# EasyEDA Pro project wukong01-Y003-HTOL - 2.eprj, board PCB1 (continued)
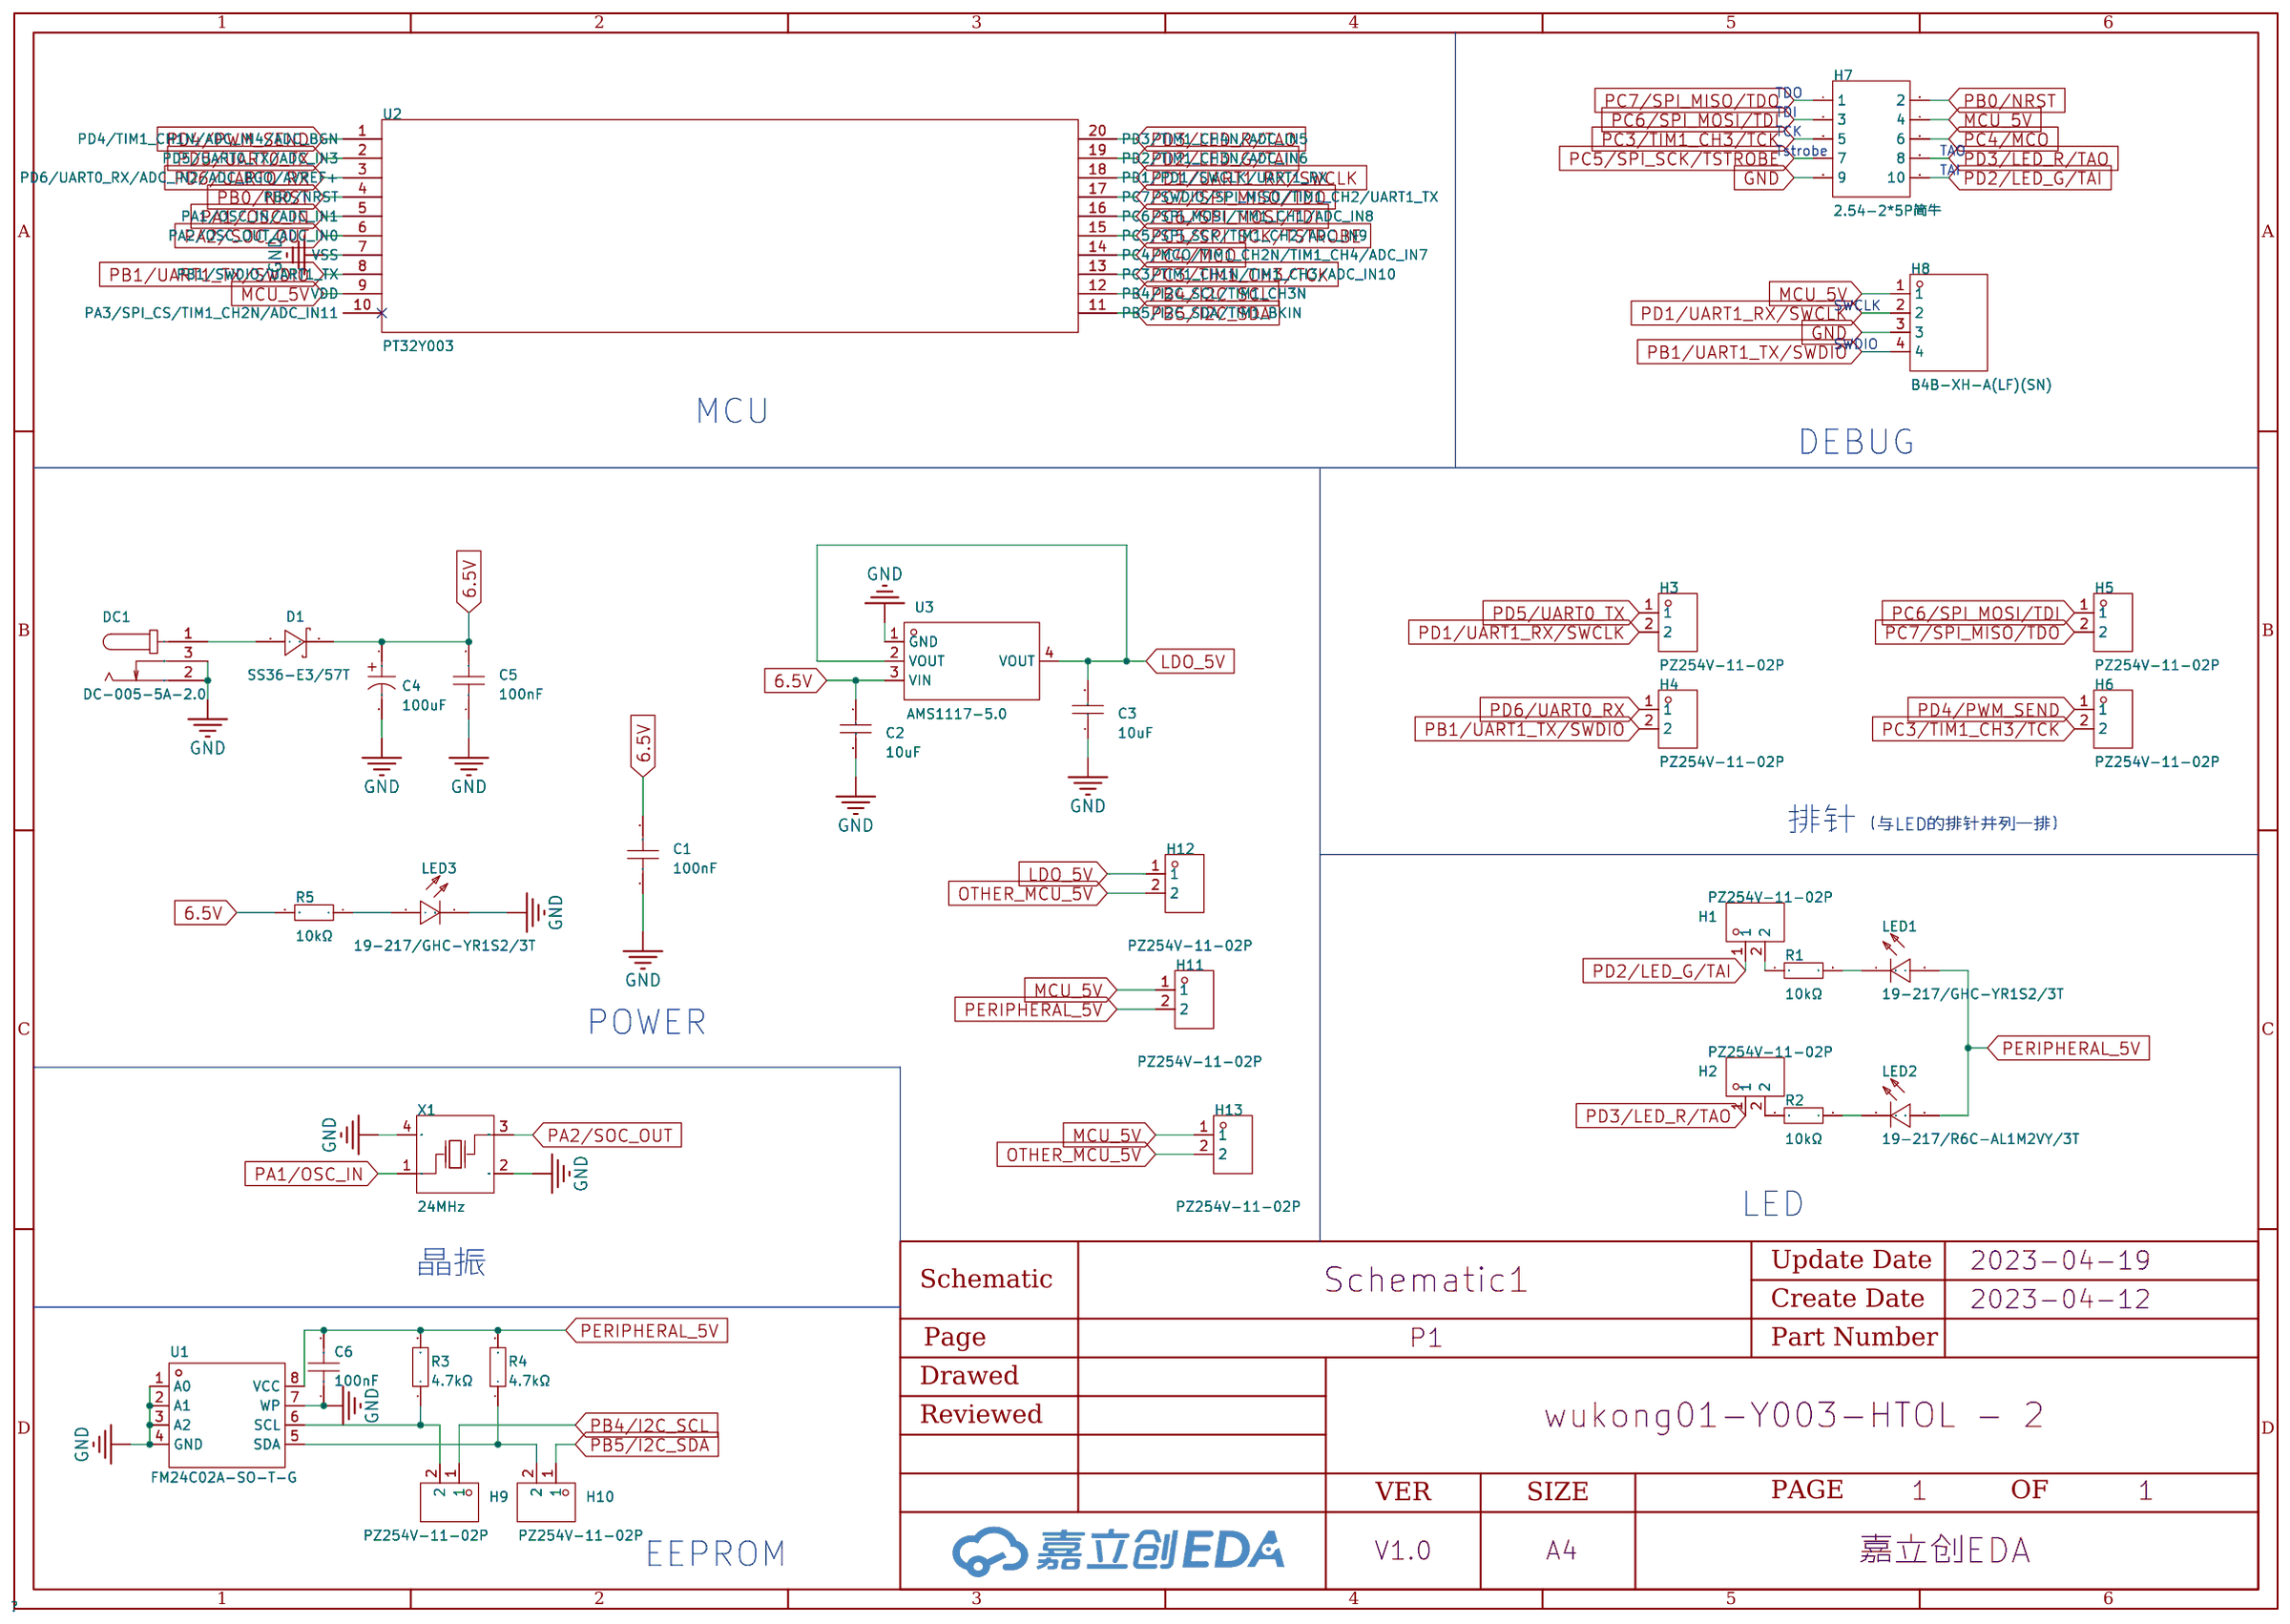
[diagram p0: schematic sheet]
## Routing (per net, layer and track width the routed paths; a pad name or vN(x,y) marks a point on that pad's centre or on a via; arc(x,y) is an arc through that point) (continued)
PD2/LED_G/TAI: length 965.4
  Top Layer w0.254: U2#20.19 217.55,99.87 v1(221.15,99.87) 227.24,99.87 H1#17.1 ; U2#4.19 217.55,213.87 v1(221.15,213.87) 227.24,213.87 H1#4.1 ; U2.19 82.55,213.87 v1(86.15,213.87) 92.24,213.87 H1.1 ; H1#2.1 137.24,213.87 v1(131.15,213.87) 127.55,213.87 U2#2.19 ; H1#13.1 137.24,137.87 v1(131.15,137.87) 127.55,137.87 U2#12.19 ; H1#10.1 47.24,175.87 v1(41.15,175.87) 37.55,175.87 U2#10.19 ; U2#6.19 127.55,175.87 v1(131.15,175.87) 137.24,175.87 H1#7.1 ; U2#21.19 262.55,99.87 v1(266.15,99.87) 272.24,99.87 H1#21.1 ; H1#11.1 227.24,137.87 v1(221.15,137.87) 217.55,137.87 U2#14.19 ; H1#22.1 47.24,99.87 v1(41.15,99.87) 37.55,99.87 U2#22.19 ; H1#25.1 137.24,61.87 v1(131.15,61.87) 127.55,61.87 U2#24.19 ; U2#17.19 82.55,99.87 v1(86.15,99.87) 92.24,99.87 H1#18.1 ; H1#20.1 182.24,99.87 v1(176.15,99.87) 172.55,99.87 U2#19.19 ; H1#27.1 272.24,61.87 v1(266.15,61.87) 262.55,61.87 U2#27.19 ; U2#8.19 217.55,175.87 v1(221.15,175.87) 227.24,175.87 H1#5.1 ; H1#23.1 227.24,61.87 v1(221.15,61.87) 217.55,61.87 U2#26.19 ; U2#16.19 37.55,137.87 v1(41.15,137.87) 47.24,137.87 H1#16.1 ; H1#3.1 182.24,213.87 v1(176.15,213.87) 172.55,213.87 U2#3.19 ; H1#28.1 47.24,61.87 v1(41.15,61.87) 37.55,61.87 U2#28.19 ; H1#26.1 182.24,61.87 v1(176.15,61.87) 172.55,61.87 U2#25.19 ; H1#14.1 182.24,137.87 v1(176.15,137.87) 172.55,137.87 U2#13.19 ; U2#5.19 82.55,175.87 v1(86.15,175.87) 92.24,175.87 H1#6.1 ; U2#15.19 262.55,137.87 v1(266.15,137.87) 272.24,137.87 H1#15.1 ; U2#11.19 82.55,137.87 v1(86.15,137.87) 92.24,137.87 H1#12.1 ; U2#7.19 172.55,175.87 v1(176.15,175.87) 182.24,175.87 H1#8.1 ; U2#30.19 127.55,23.87 v1(131.15,23.87) 137.24,23.87 H1#31.1 ; U2#32.19 217.55,23.87 v1(221.15,23.87) 227.24,23.87 H1#29.1 ; H1#30.1 92.24,23.87 v1(86.15,23.87) 82.55,23.87 U2#29.19 ; H1#19.1 137.24,99.87 v1(131.15,99.87) 127.55,99.87 U2#18.19 ; U2#31.19 172.55,23.87 v1(176.15,23.87) 182.24,23.87 H1#32.1 ; U2#9.19 262.55,175.87 v1(266.15,175.87) 272.24,175.87 H1#9.1 ; U2#23.19 82.55,61.87 v1(86.15,61.87) 92.24,61.87 H1#24.1
  Bottom Layer w0.254: H7#16.10 254.59,144.73 255.48,143.84 265.51,143.84 266.15,143.2 v1(266.15,137.87) ; v1(131.15,175.87) 131.15,181.2 130.51,181.84 120.48,181.84 119.59,182.73 H7#6.10 ; 209.59,31.87 209.59,30.73 210.48,29.84 220.51,29.84 221.15,29.2 v1(221.15,23.87) ; H7#13.10 164.59,144.73 165.48,143.84 175.51,143.84 176.15,143.2 v1(176.15,137.87) ; v1(86.15,99.87) 86.15,105.2 85.51,105.84 75.48,105.84 74.59,106.73 H7#17.10 ; H7#9.10 29.59,182.73 30.48,181.84 40.51,181.84 41.15,181.2 v1(41.15,175.87) ; v1(176.15,99.87) 176.15,105.2 175.51,105.84 165.48,105.84 164.59,106.73 H7#19.10 ; v1(86.15,61.87) 86.15,67.2 85.51,67.84 75.48,67.84 74.59,68.73 74.59,69.87 ; v1(176.15,23.87) 176.15,29.2 175.51,29.84 165.48,29.84 164.59,30.73 164.59,31.87 ; H7#7.10 164.59,182.73 165.48,181.84 175.51,181.84 176.15,181.2 v1(176.15,175.87) ; v1(131.15,23.87) 131.15,29.2 130.51,29.84 120.48,29.84 119.59,30.73 119.59,31.87 ; v1(221.15,99.87) 221.15,105.2 220.51,105.84 210.48,105.84 209.59,106.73 H7#20.10 ; v1(221.15,61.87) 221.15,67.2 220.51,67.84 210.48,67.84 209.59,68.73 209.59,69.87 ; H7.10 74.59,220.73 75.48,219.84 85.51,219.84 86.15,219.2 v1(86.15,213.87) ; H7#21.10 29.59,106.73 30.48,105.84 40.51,105.84 41.15,105.2 v1(41.15,99.87) ; H7#22.10 254.59,106.73 255.48,105.84 265.51,105.84 266.15,105.2 v1(266.15,99.87) ; v1(176.15,61.87) 176.15,67.2 175.51,67.84 165.48,67.84 164.59,68.73 164.59,69.87 ; H7#18.10 119.59,106.73 120.48,105.84 130.51,105.84 131.15,105.2 v1(131.15,99.87) ; H7#14.10 209.59,144.73 210.48,143.84 220.51,143.84 221.15,143.2 v1(221.15,137.87) ; H7#10.10 254.59,182.73 255.48,181.84 265.51,181.84 266.15,181.2 v1(266.15,175.87) ; H7#4.10 209.59,220.73 210.48,219.84 220.51,219.84 221.15,219.2 v1(221.15,213.87) ; v1(221.15,175.87) 221.15,181.2 220.51,181.84 210.48,181.84 209.59,182.73 H7#8.10 ; v1(266.15,61.87) 266.15,67.2 265.51,67.84 255.48,67.84 254.59,68.73 254.59,69.87 ; 74.59,31.87 74.59,30.73 75.48,29.84 85.51,29.84 86.15,29.2 v1(86.15,23.87) ; H7#3.10 164.59,220.73 165.48,219.84 175.51,219.84 176.15,219.2 v1(176.15,213.87) ; H7#11.10 74.59,144.73 75.48,143.84 85.51,143.84 86.15,143.2 v1(86.15,137.87) ; H7#15.10 29.59,144.73 30.48,143.84 40.51,143.84 41.15,143.2 v1(41.15,137.87) ; v1(41.15,61.87) 41.15,67.2 40.51,67.84 30.48,67.84 29.59,68.73 29.59,69.87 ; v1(131.15,61.87) 131.15,67.2 130.51,67.84 120.48,67.84 119.59,68.73 119.59,69.87 ; H7#5.10 74.59,182.73 75.48,181.84 85.51,181.84 86.15,181.2 v1(86.15,175.87) ; v1(131.15,213.87) 131.15,219.2 130.51,219.84 120.48,219.84 119.59,220.73 H7#2.10 ; H7#12.10 119.59,144.73 120.48,143.84 130.51,143.84 131.15,143.2 v1(131.15,137.87)
PD3/LED_R/TAO: length 921
  Top Layer w0.254: v1(77.13,181.2) H7#5.8 ; H2#25.1 227.5,65.68 226.99,65.17 226.99,63.39 226.1,62.5 v1(220.51,62.5) 217.55,62.5 U2#26.20 ; H2#21.1 272.5,103.68 271.99,103.17 271.99,101.39 271.1,100.5 v1(265.51,100.5) 262.55,100.5 U2#21.20 ; v1(212.13,105.2) H7#20.8 ; H2#17.1 92.5,103.68 91.99,103.17 91.99,101.39 91.1,100.5 v1(85.51,100.5) 82.55,100.5 U2#17.20 ; v1(77.13,29.2) 77.13,31.87 ; v1(167.13,29.2) 167.13,31.87 ; U2#30.20 127.55,24.5 v1(130.51,24.5) 136.1,24.5 136.99,25.39 136.99,27.17 137.5,27.68 H2#32.1 ; H2#5.1 92.5,179.68 91.99,179.17 91.99,177.39 91.1,176.5 v1(85.51,176.5) 82.55,176.5 U2#5.20 ; v1(167.13,181.2) H7#7.8 ; H2#30.1 182.5,27.68 181.99,27.17 181.99,25.39 181.1,24.5 v1(175.51,24.5) 172.55,24.5 U2#31.20 ; U2#12.20 127.55,138.5 v1(130.51,138.5) 136.1,138.5 136.99,139.39 136.99,141.17 137.5,141.68 H2#14.1 ; H2#7.1 227.5,179.68 226.99,179.17 226.99,177.39 226.1,176.5 v1(220.51,176.5) 217.55,176.5 U2#8.20 ; U2#32.20 217.55,24.5 v1(220.51,24.5) 226.1,24.5 226.99,25.39 226.99,27.17 227.5,27.68 H2#31.1 ; H2#3.1 182.5,217.68 181.99,217.17 181.99,215.39 181.1,214.5 v1(175.51,214.5) 172.55,214.5 U2#3.20 ; v1(167.13,105.2) H7#19.8 ; H2#29.1 92.5,27.68 91.99,27.17 91.99,25.39 91.1,24.5 v1(85.51,24.5) 82.55,24.5 U2#29.20 ; v1(257.13,143.2) H7#16.8 ; v1(212.13,181.2) H7#8.8 ; H2#24.1 182.5,65.68 181.99,65.17 181.99,63.39 181.1,62.5 v1(175.51,62.5) 172.55,62.5 U2#25.20 ; H2#8.1 137.5,179.68 136.99,179.17 136.99,177.39 136.1,176.5 v1(130.51,176.5) 127.55,176.5 U2#6.20 ; U2.20 82.55,214.5 v1(85.51,214.5) 91.1,214.5 91.99,215.39 91.99,217.17 92.5,217.68 H2.1 ; v1(122.13,67.2) 122.13,69.87 ; U2#9.20 262.55,176.5 v1(265.51,176.5) 271.1,176.5 271.99,177.39 271.99,179.17 272.5,179.68 H2#9.1 ; H2#18.1 182.5,103.68 181.99,103.17 181.99,101.39 181.1,100.5 v1(175.51,100.5) 172.55,100.5 U2#19.20 ; v1(77.13,105.2) H7#17.8 ; U2#7.20 172.55,176.5 v1(175.51,176.5) 181.1,176.5 181.99,177.39 181.99,179.17 182.5,179.68 H2#6.1 ; v1(32.13,143.2) H7#15.8 ; U2#13.20 172.55,138.5 v1(175.51,138.5) 181.1,138.5 181.99,139.39 181.99,141.17 182.5,141.68 H2#12.1 ; H2#19.1 227.5,103.68 226.99,103.17 226.99,101.39 226.1,100.5 v1(220.51,100.5) 217.55,100.5 U2#20.20 ; v1(122.13,105.2) H7#18.8 ; H2#26.1 137.5,65.68 136.99,65.17 136.99,63.39 136.1,62.5 v1(130.51,62.5) 127.55,62.5 U2#24.20 ; v1(122.13,29.2) 122.13,31.87 ; v1(32.13,105.2) H7#21.8 ; v1(167.13,219.2) H7#3.8 ; U2#15.20 262.55,138.5 v1(265.51,138.5) 271.1,138.5 271.99,139.39 271.99,141.17 272.5,141.68 H2#15.1 ; v1(257.13,67.2) 257.13,69.87 ; v1(122.13,143.2) H7#12.8 ; U2#27.20 262.55,62.5 v1(265.51,62.5) 271.1,62.5 271.99,63.39 271.99,65.17 272.5,65.68 H2#27.1 ; v1(77.13,143.2) H7#11.8 ; U2#2.20 127.55,214.5 v1(130.51,214.5) 136.1,214.5 136.99,215.39 136.99,217.17 137.5,217.68 H2#2.1 ; v1(32.13,67.2) 32.13,69.87 ; U2#23.20 82.55,62.5 v1(85.51,62.5) 91.1,62.5 91.99,63.39 91.99,65.17 92.5,65.68 H2#23.1 ; H2#28.1 47.5,65.68 46.99,65.17 46.99,63.39 46.1,62.5 v1(40.51,62.5) 37.55,62.5 U2#28.20 ; U2#22.20 37.55,100.5 v1(40.51,100.5) 46.1,100.5 46.99,101.39 46.99,103.17 47.5,103.68 H2#22.1 ; U2#16.20 37.55,138.5 v1(40.51,138.5) 46.1,138.5 46.99,139.39 46.99,141.17 47.5,141.68 H2#16.1 ; H2#20.1 137.5,103.68 136.99,103.17 136.99,101.39 136.1,100.5 v1(130.51,100.5) 127.55,100.5 U2#18.20 ; v1(122.13,219.2) H7#2.8 ; H2#13.1 227.5,141.68 226.99,141.17 226.99,139.39 226.1,138.5 v1(220.51,138.5) 217.55,138.5 U2#14.20 ; H2#11.1 92.5,141.68 91.99,141.17 91.99,139.39 91.1,138.5 v1(85.51,138.5) 82.55,138.5 U2#11.20 ; U2#10.20 37.55,176.5 v1(40.51,176.5) 46.1,176.5 46.99,177.39 46.99,179.17 47.5,179.68 H2#10.1 ; v1(122.13,181.2) H7#6.8 ; U2#4.20 217.55,214.5 v1(220.51,214.5) 226.1,214.5 226.99,215.39 226.99,217.17 227.5,217.68 H2#4.1 ; v1(167.13,67.2) 167.13,69.87 ; v1(77.13,219.2) H7.8 ; v1(257.13,105.2) H7#22.8 ; v1(212.13,29.2) 212.13,31.87 ; v1(167.13,143.2) H7#13.8 ; v1(212.13,219.2) H7#4.8 ; v1(77.13,67.2) 77.13,69.87 ; v1(257.13,181.2) H7#10.8 ; v1(32.13,181.2) H7#9.8 ; v1(212.13,67.2) 212.13,69.87 ; v1(212.13,143.2) H7#14.8
  Bottom Layer w0.254: v1(257.13,105.2) 265,105.2 265.51,104.69 v1(265.51,100.5) ; v1(122.13,29.2) 130,29.2 130.51,28.69 v1(130.51,24.5) ; v1(212.13,67.2) 220,67.2 220.51,66.69 v1(220.51,62.5) ; v1(167.13,29.2) 175,29.2 175.51,28.69 v1(175.51,24.5) ; v1(85.51,214.5) 85.51,218.69 85.01,219.2 v1(77.13,219.2) ; v1(122.13,181.2) 130,181.2 130.51,180.69 v1(130.51,176.5) ; v1(85.51,62.5) 85.51,66.69 85.01,67.2 v1(77.13,67.2) ; v1(257.13,67.2) 265,67.2 265.51,66.69 v1(265.51,62.5) ; v1(257.13,143.2) 265,143.2 265.51,142.69 v1(265.51,138.5) ; v1(220.51,138.5) 220.51,142.69 220,143.2 v1(212.13,143.2) ; v1(40.51,138.5) 40.51,142.69 40.01,143.2 v1(32.13,143.2) ; v1(167.13,219.2) 175,219.2 175.51,218.69 v1(175.51,214.5) ; v1(220.51,100.5) 220.51,104.69 220,105.2 v1(212.13,105.2) ; v1(32.13,105.2) 40.01,105.2 40.51,104.69 v1(40.51,100.5) ; v1(40.51,176.5) 40.51,180.69 40.01,181.2 v1(32.13,181.2) ; v1(122.13,143.2) 130,143.2 130.51,142.69 v1(130.51,138.5) ; v1(85.51,176.5) 85.51,180.69 85.01,181.2 v1(77.13,181.2) ; v1(77.13,143.2) 85.01,143.2 85.51,142.69 v1(85.51,138.5) ; v1(167.13,143.2) 175,143.2 175.51,142.69 v1(175.51,138.5) ; v1(175.51,100.5) 175.51,104.69 175,105.2 v1(167.13,105.2) ; v1(220.51,214.5) 220.51,218.69 220,219.2 v1(212.13,219.2) ; v1(130.51,62.5) 130.51,66.69 130,67.2 v1(122.13,67.2) ; v1(175.51,62.5) 175.51,66.69 175,67.2 v1(167.13,67.2) ; v1(85.51,100.5) 85.51,104.69 85.01,105.2 v1(77.13,105.2) ; v1(40.51,62.5) 40.51,66.69 40.01,67.2 v1(32.13,67.2) ; v1(220.51,24.5) 220.51,28.69 220,29.2 v1(212.13,29.2) ; v1(85.51,24.5) 85.51,28.69 85.01,29.2 v1(77.13,29.2) ; v1(122.13,219.2) 130,219.2 130.51,218.69 v1(130.51,214.5) ; v1(220.51,176.5) 220.51,180.69 220,181.2 v1(212.13,181.2) ; v1(175.51,176.5) 175.51,180.69 175,181.2 v1(167.13,181.2) ; v1(130.51,100.5) 130.51,104.69 130,105.2 v1(122.13,105.2) ; v1(265.51,176.5) 265.51,180.69 265,181.2 v1(257.13,181.2)
PD4/PWM_SEND: length 756.9
  Top Layer w0.254: U2#19.1 165.86,100.51 165.66,100.71 165.66,101.06 165.86,101.27 180.72,101.27 181.48,102.03 181.48,105.58 182.12,106.22 H6#20.1 ; U2#10.1 30.86,176.51 30.66,176.71 30.66,177.06 30.86,177.26 45.72,177.26 46.48,178.03 46.48,181.58 47.12,182.22 H6#10.1 ; U2#23.1 75.86,62.51 75.66,62.71 75.66,63.06 75.86,63.26 90.72,63.26 91.48,64.03 91.48,67.58 92.12,68.22 H6#23.1 ; U2#16.1 30.86,138.51 30.66,138.71 30.66,139.06 30.86,139.26 45.72,139.26 46.48,140.03 46.48,143.58 47.12,144.22 H6#16.1 ; H6.1 92.12,220.22 91.48,219.58 91.48,216.03 90.72,215.26 75.86,215.26 75.66,215.06 75.66,214.71 75.86,214.51 U2.1 ; U2#9.1 255.86,176.51 255.66,176.71 255.66,177.06 255.86,177.26 270.72,177.26 271.48,178.03 271.48,181.58 272.12,182.22 H6#9.1 ; U2#29.1 75.86,24.51 75.66,24.71 75.66,25.06 75.86,25.26 90.72,25.26 91.48,26.03 91.48,29.58 92.12,30.22 H6#29.1 ; H6#5.1 92.12,182.22 91.48,181.58 91.48,178.03 90.72,177.26 75.86,177.26 75.66,177.06 75.66,176.71 75.86,176.51 U2#5.1 ; U2#20.1 210.86,100.51 210.66,100.71 210.66,101.06 210.86,101.27 225.72,101.27 226.48,102.03 226.48,105.58 227.12,106.22 H6#18.1 ; H6#11.1 92.12,144.22 91.48,143.58 91.48,140.03 90.72,139.26 75.86,139.26 75.66,139.06 75.66,138.71 75.86,138.51 U2#11.1 ; U2#7.1 165.86,176.51 165.66,176.71 165.66,177.06 165.86,177.26 180.72,177.26 181.48,178.03 181.48,181.58 182.12,182.22 H6#8.1 ; H6#21.1 272.12,106.22 271.48,105.58 271.48,102.03 270.72,101.27 255.86,101.27 255.66,101.06 255.66,100.71 255.86,100.51 U2#21.1 ; U2#31.1 165.86,24.51 165.66,24.71 165.66,25.06 165.86,25.26 180.72,25.26 181.48,26.03 181.48,29.58 182.12,30.22 H6#32.1 ; H6#3.1 182.12,220.22 181.48,219.58 181.48,216.03 180.72,215.26 165.86,215.26 165.66,215.06 165.66,214.71 165.86,214.51 U2#3.1 ; U2#15.1 255.86,138.51 255.66,138.71 255.66,139.06 255.86,139.26 270.72,139.26 271.48,140.03 271.48,143.58 272.12,144.22 H6#15.1 ; H6#28.1 47.12,68.22 46.48,67.58 46.48,64.03 45.72,63.26 30.86,63.26 30.66,63.06 30.66,62.71 30.86,62.51 U2#28.1 ; U2#13.1 165.86,138.51 165.66,138.71 165.66,139.06 165.86,139.26 180.72,139.26 181.48,140.03 181.48,143.58 182.12,144.22 H6#14.1 ; U2#17.1 75.86,100.51 75.66,100.71 75.66,101.06 75.86,101.27 90.72,101.27 91.48,102.03 91.48,105.58 92.12,106.22 H6#17.1 ; H6#26.1 182.12,68.22 181.48,67.58 181.48,64.03 180.72,63.26 165.86,63.26 165.66,63.06 165.66,62.71 165.86,62.51 U2#25.1 ; H6#7.1 137.12,182.22 136.48,181.58 136.48,178.03 135.72,177.26 120.86,177.26 120.66,177.06 120.66,176.71 120.86,176.51 U2#6.1 ; U2#26.1 210.86,62.51 210.66,62.71 210.66,63.06 210.86,63.26 225.72,63.26 226.48,64.03 226.48,67.58 227.12,68.22 H6#24.1 ; U2#18.1 120.86,100.51 120.66,100.71 120.66,101.06 120.86,101.27 135.72,101.27 136.48,102.03 136.48,105.58 137.12,106.22 H6#19.1 ; U2#32.1 210.86,24.51 210.66,24.71 210.66,25.06 210.86,25.26 225.72,25.26 226.48,26.03 226.48,29.58 227.12,30.22 H6#30.1 ; U2#12.1 120.86,138.51 120.66,138.71 120.66,139.06 120.86,139.26 135.72,139.26 136.48,140.03 136.48,143.58 137.12,144.22 H6#13.1 ; H6#2.1 137.12,220.22 136.48,219.58 136.48,216.03 135.72,215.26 120.86,215.26 120.66,215.06 120.66,214.71 120.86,214.51 U2#2.1 ; U2#4.1 210.86,214.51 210.66,214.71 210.66,215.06 210.86,215.26 225.72,215.26 226.48,216.03 226.48,219.58 227.12,220.22 H6#4.1 ; U2#8.1 210.86,176.51 210.66,176.71 210.66,177.06 210.86,177.26 225.72,177.26 226.48,178.03 226.48,181.58 227.12,182.22 H6#6.1 ; H6#27.1 272.12,68.22 271.48,67.58 271.48,64.03 270.72,63.26 255.86,63.26 255.66,63.06 255.66,62.71 255.86,62.51 U2#27.1 ; H6#12.1 227.12,144.22 226.48,143.58 226.48,140.03 225.72,139.26 210.86,139.26 210.66,139.06 210.66,138.71 210.86,138.51 U2#14.1 ; U2#30.1 120.86,24.51 120.66,24.71 120.66,25.06 120.86,25.26 135.72,25.26 136.48,26.03 136.48,29.58 137.12,30.22 H6#31.1 ; H6#25.1 137.12,68.22 136.48,67.58 136.48,64.03 135.72,63.26 120.86,63.26 120.66,63.06 120.66,62.71 120.86,62.51 U2#24.1 ; H6#22.1 47.12,106.22 46.48,105.58 46.48,102.03 45.72,101.27 30.86,101.27 30.66,101.06 30.66,100.71 30.86,100.51 U2#22.1
PD5/UART0_TX: length 901.2
  Top Layer w0.254: H3#26.1 183.39,70.63 181.99,70.63 181.1,69.74 181.1,64.66 180.21,63.77 165.1,63.77 164.8,63.48 164.8,62.12 165.07,61.86 U2#25.2 ; U2#5.2 75.07,175.86 74.81,176.12 74.81,177.48 75.1,177.77 90.21,177.77 91.1,178.66 91.1,183.74 91.99,184.63 93.39,184.63 H3#5.1 ; U2#20.2 210.07,99.86 209.8,100.12 209.8,101.48 210.1,101.77 225.21,101.77 226.1,102.66 226.1,107.74 226.99,108.63 228.39,108.63 H3#19.1 ; U2#26.2 210.07,61.86 209.8,62.12 209.8,63.48 210.1,63.77 225.21,63.77 226.1,64.66 226.1,69.74 226.99,70.63 228.39,70.63 H3#25.1 ; U2#16.2 30.07,137.86 29.8,138.12 29.8,139.48 30.1,139.77 45.21,139.77 46.1,140.66 46.1,145.74 46.99,146.63 48.39,146.63 H3#17.1 ; U2#24.2 120.07,61.86 119.81,62.12 119.81,63.48 120.1,63.77 135.21,63.77 136.1,64.66 136.1,69.74 136.99,70.63 138.39,70.63 H3#12.1 ; U2#32.2 210.07,23.86 209.8,24.12 209.8,25.48 210.1,25.77 225.21,25.77 226.1,26.66 226.1,31.74 226.99,32.63 228.39,32.63 H3#30.1 ; H3#28.1 48.39,70.63 46.99,70.63 46.1,69.74 46.1,64.66 45.21,63.77 30.1,63.77 29.8,63.48 29.8,62.12 30.07,61.86 U2#28.2 ; U2#22.2 30.07,99.86 29.8,100.12 29.8,101.48 30.1,101.77 45.21,101.77 46.1,102.66 46.1,107.74 46.99,108.63 48.39,108.63 H3#23.1 ; U2#13.2 165.07,137.86 164.8,138.12 164.8,139.48 165.1,139.77 180.21,139.77 181.1,140.66 181.1,145.74 181.99,146.63 183.39,146.63 H3#15.1 ; U2#17.2 75.07,99.86 74.81,100.12 74.81,101.48 75.1,101.77 90.21,101.77 91.1,102.66 91.1,107.74 91.99,108.63 93.39,108.63 H3#18.1 ; U2#9.2 255.07,175.86 254.81,176.12 254.81,177.48 255.1,177.77 270.21,177.77 271.1,178.66 271.1,183.74 271.99,184.63 273.39,184.63 H3#9.1 ; H3#32.1 183.39,32.63 181.99,32.63 181.1,31.74 181.1,26.66 180.21,25.77 165.1,25.77 164.8,25.48 164.8,24.12 165.07,23.86 U2#31.2 ; H3.1 93.39,222.63 91.99,222.63 91.1,221.74 91.1,216.66 90.21,215.77 75.1,215.77 74.81,215.48 74.81,214.12 75.07,213.86 U2.2 ; U2#7.2 165.07,175.86 164.8,176.12 164.8,177.48 165.1,177.77 180.21,177.77 181.1,178.66 181.1,183.74 181.99,184.63 183.39,184.63 H3#8.1 ; U2#29.2 75.07,23.86 74.81,24.12 74.81,25.48 75.1,25.77 90.21,25.77 91.1,26.66 91.1,31.74 91.99,32.63 93.39,32.63 H3#29.1 ; U2#2.2 120.07,213.86 119.81,214.12 119.81,215.48 120.1,215.77 135.21,215.77 136.1,216.66 136.1,221.74 136.99,222.63 138.39,222.63 H3#2.1 ; H3#16.1 273.39,146.63 271.99,146.63 271.1,145.74 271.1,140.66 270.21,139.77 255.1,139.77 254.81,139.48 254.81,138.12 255.07,137.86 U2#15.2 ; U2#4.2 210.07,213.86 209.8,214.12 209.8,215.48 210.1,215.77 225.21,215.77 226.1,216.66 226.1,221.74 226.99,222.63 228.39,222.63 H3#4.1 ; H3#11.1 93.39,146.63 91.99,146.63 91.1,145.74 91.1,140.66 90.21,139.77 75.1,139.77 74.81,139.48 74.81,138.12 75.07,137.86 U2#11.2 ; H3#3.1 183.39,222.63 181.99,222.63 181.1,221.74 181.1,216.66 180.21,215.77 165.1,215.77 164.8,215.48 164.8,214.12 165.07,213.86 U2#3.2 ; H3#13.1 228.39,146.63 226.99,146.63 226.1,145.74 226.1,140.66 225.21,139.77 210.1,139.77 209.8,139.48 209.8,138.12 210.07,137.86 U2#14.2 ; H3#14.1 138.39,146.63 136.99,146.63 136.1,145.74 136.1,140.66 135.21,139.77 120.1,139.77 119.81,139.48 119.81,138.12 120.07,137.86 U2#12.2 ; U2#21.2 255.07,99.86 254.81,100.12 254.81,101.48 255.1,101.77 270.21,101.77 271.1,102.66 271.1,107.74 271.99,108.63 273.39,108.63 H3#22.1 ; H3#10.1 48.39,184.63 46.99,184.63 46.1,183.74 46.1,178.66 45.21,177.77 30.1,177.77 29.8,177.48 29.8,176.12 30.07,175.86 U2#10.2 ; U2#27.2 255.07,61.86 254.81,62.12 254.81,63.48 255.1,63.77 270.21,63.77 271.1,64.66 271.1,69.74 271.99,70.63 273.39,70.63 H3#27.1 ; U2#18.2 120.07,99.86 119.81,100.12 119.81,101.48 120.1,101.77 135.21,101.77 136.1,102.66 136.1,107.74 136.99,108.63 138.39,108.63 H3#20.1 ; U2#23.2 75.07,61.86 74.81,62.12 74.81,63.48 75.1,63.77 90.21,63.77 91.1,64.66 91.1,69.74 91.99,70.63 93.39,70.63 H3#24.1 ; H3#21.1 183.39,108.63 181.99,108.63 181.1,107.74 181.1,102.66 180.21,101.77 165.1,101.77 164.8,101.48 164.8,100.12 165.07,99.86 U2#19.2 ; U2#8.2 210.07,175.86 209.8,176.12 209.8,177.48 210.1,177.77 225.21,177.77 226.1,178.66 226.1,183.74 226.99,184.63 228.39,184.63 H3#6.1 ; U2#6.2 120.07,175.86 119.81,176.12 119.81,177.48 120.1,177.77 135.21,177.77 136.1,178.66 136.1,183.74 136.99,184.63 138.39,184.63 H3#7.1 ; H3#31.1 138.39,32.63 136.99,32.63 136.1,31.74 136.1,26.66 135.21,25.77 120.1,25.77 119.81,25.48 119.81,24.12 120.07,23.86 U2#30.2
PD6/UART0_RX: length 1019.4
  Top Layer w0.254: H4#21.1 181.99,111.3 180.59,109.9 180.59,103.17 179.83,102.41 164.97,102.41 164.34,101.77 164.34,99.61 164.72,99.23 166.77,99.23 U2#19.3 ; U2#3.3 166.77,213.23 164.72,213.23 164.34,213.61 164.34,215.77 164.97,216.41 179.83,216.41 180.59,217.17 180.59,223.9 181.99,225.3 H4#3.1 ; H4#32.1 181.99,35.3 180.59,33.9 180.59,27.17 179.83,26.41 164.97,26.41 164.34,25.77 164.34,23.61 164.72,23.23 166.77,23.23 U2#31.3 ; U2#7.3 166.77,175.23 164.72,175.23 164.34,175.61 164.34,177.77 164.97,178.41 179.83,178.41 180.59,179.17 180.59,185.9 181.99,187.3 H4#9.1 ; H4#17.1 226.99,111.3 225.59,109.9 225.59,103.17 224.83,102.41 209.97,102.41 209.34,101.77 209.34,99.61 209.72,99.23 211.77,99.23 U2#20.3 ; U2#12.3 121.77,137.23 119.72,137.23 119.34,137.61 119.34,139.77 119.97,140.41 134.83,140.41 135.59,141.17 135.59,147.9 136.99,149.3 H4#13.1 ; H4#19.1 136.99,111.3 135.59,109.9 135.59,103.17 134.83,102.41 119.97,102.41 119.34,101.77 119.34,99.61 119.72,99.23 121.77,99.23 U2#18.3 ; U2#26.3 211.77,61.23 209.72,61.23 209.34,61.61 209.34,63.77 209.97,64.41 224.83,64.41 225.59,65.17 225.59,71.9 226.99,73.3 H4#23.1 ; H4#18.1 91.99,111.3 90.59,109.9 90.59,103.17 89.83,102.41 74.97,102.41 74.34,101.77 74.34,99.61 74.72,99.23 76.77,99.23 U2#17.3 ; U2#32.3 211.77,23.23 209.72,23.23 209.34,23.61 209.34,25.77 209.97,26.41 224.83,26.41 225.59,27.17 225.59,33.9 226.99,35.3 H4#29.1 ; U2#25.3 166.77,61.23 164.72,61.23 164.34,61.61 164.34,63.77 164.97,64.41 179.83,64.41 180.59,65.17 180.59,71.9 181.99,73.3 H4#27.1 ; U2#15.3 256.77,137.23 254.72,137.23 254.34,137.61 254.34,139.77 254.97,140.41 269.83,140.41 270.59,141.17 270.59,147.9 271.99,149.3 H4#16.1 ; U2#24.3 121.77,61.23 119.72,61.23 119.34,61.61 119.34,63.77 119.97,64.41 134.83,64.41 135.59,65.17 135.59,71.9 136.99,73.3 H4#25.1 ; U2#29.3 76.77,23.23 74.72,23.23 74.34,23.61 74.34,25.77 74.97,26.41 89.83,26.41 90.59,27.17 90.59,33.9 91.99,35.3 H4#30.1 ; U2#10.3 31.77,175.23 29.72,175.23 29.34,175.61 29.34,177.77 29.97,178.41 44.83,178.41 45.59,179.17 45.59,185.9 46.99,187.3 H4#8.1 ; U2#23.3 76.77,61.23 74.72,61.23 74.34,61.61 74.34,63.77 74.97,64.41 89.83,64.41 90.59,65.17 90.59,71.9 91.99,73.3 H4#24.1 ; H4#28.1 271.99,73.3 270.59,71.9 270.59,65.17 269.83,64.41 254.97,64.41 254.34,63.77 254.34,61.61 254.72,61.23 256.77,61.23 U2#27.3 ; H4#5.1 226.99,187.3 225.59,185.9 225.59,179.17 224.83,178.41 209.97,178.41 209.34,177.77 209.34,175.61 209.72,175.23 211.77,175.23 U2#8.3 ; H4#26.1 46.99,73.3 45.59,71.9 45.59,65.17 44.83,64.41 29.97,64.41 29.34,63.77 29.34,61.61 29.72,61.23 31.77,61.23 U2#28.3 ; H4#22.1 271.99,111.3 270.59,109.9 270.59,103.17 269.83,102.41 254.97,102.41 254.34,101.77 254.34,99.61 254.72,99.23 256.77,99.23 U2#21.3 ; H4#4.1 226.99,225.3 225.59,223.9 225.59,217.17 224.83,216.41 209.97,216.41 209.34,215.77 209.34,213.61 209.72,213.23 211.77,213.23 U2#4.3 ; H4#10.1 271.99,187.3 270.59,185.9 270.59,179.17 269.83,178.41 254.97,178.41 254.34,177.77 254.34,175.61 254.72,175.23 256.77,175.23 U2#9.3 ; U2#13.3 166.77,137.23 164.72,137.23 164.34,137.61 164.34,139.77 164.97,140.41 179.83,140.41 180.59,141.17 180.59,147.9 181.99,149.3 H4#15.1 ; U2#2.3 121.77,213.23 119.72,213.23 119.34,213.61 119.34,215.77 119.97,216.41 134.83,216.41 135.59,217.17 135.59,223.9 136.99,225.3 H4#2.1 ; U2#14.3 211.77,137.23 209.72,137.23 209.34,137.61 209.34,139.77 209.97,140.41 224.83,140.41 225.59,141.17 225.59,147.9 226.99,149.3 H4#11.1 ; U2#11.3 76.77,137.23 74.72,137.23 74.34,137.61 74.34,139.77 74.97,140.41 89.83,140.41 90.59,141.17 90.59,147.9 91.99,149.3 H4#12.1 ; U2#30.3 121.77,23.23 119.72,23.23 119.34,23.61 119.34,25.77 119.97,26.41 134.83,26.41 135.59,27.17 135.59,33.9 136.99,35.3 H4#31.1 ; U2#16.3 31.77,137.23 29.72,137.23 29.34,137.61 29.34,139.77 29.97,140.41 44.83,140.41 45.59,141.17 45.59,147.9 46.99,149.3 H4#14.1 ; U2#5.3 76.77,175.23 74.72,175.23 74.34,175.61 74.34,177.77 74.97,178.41 89.83,178.41 90.59,179.17 90.59,185.9 91.99,187.3 H4#6.1 ; H4#20.1 46.99,111.3 45.59,109.9 45.59,103.17 44.83,102.41 29.97,102.41 29.34,101.77 29.34,99.61 29.72,99.23 31.77,99.23 U2#22.3 ; U2.3 76.77,213.23 74.72,213.23 74.34,213.61 74.34,215.77 74.97,216.41 89.83,216.41 90.59,217.17 90.59,223.9 91.99,225.3 H4.1 ; H4#7.1 136.99,187.3 135.59,185.9 135.59,179.17 134.83,178.41 119.97,178.41 119.34,177.77 119.34,175.61 119.72,175.23 121.77,175.23 U2#6.3
PERIPHERAL_5V: length 2043.3
  Top Layer w0.5: 28.71,51.74 35.38,51.74 LED2#28.1 35.47,50.36 35.56,50.27 v1(35.56,45.1) 30.1,45.1 28.64,46.56 C6#28.2 28.58,53.81 28.58,55.01 28.19,55.39 22.73,55.39 22.35,55.01 22.35,54.4 U1#28.8 ; v1(142.83,121.1) 142.83,128.98 H11#12.2 ; 202.2,92.25 202.35,92.4 202.35,93.01 202.73,93.39 208.19,93.39 208.57,93.01 208.57,91.81 C6#20.2 208.64,84.56 210.1,83.1 v1(215.56,83.1) 215.56,88.27 215.47,88.36 LED2#20.1 215.38,89.74 208.71,89.74 ; 202.2,54.25 202.35,54.4 202.35,55.01 202.73,55.39 208.19,55.39 208.57,55.01 208.57,53.81 C6#26.2 208.64,46.56 210.1,45.1 v1(215.56,45.1) 215.56,50.27 215.47,50.36 LED2#26.1 215.38,51.74 208.71,51.74 ; v1(187.83,7.1) 187.83,14.98 H11#32.2 ; H11#31.2 97.83,14.98 v1(97.83,7.1) ; 73.71,13.74 80.38,13.74 LED2#30.1 80.47,12.36 80.56,12.27 v1(80.56,7.1) 75.1,7.1 73.64,8.56 73.64,15.74 73.58,15.81 73.58,17.01 73.19,17.39 67.73,17.39 67.35,17.01 67.35,16.4 U1#29.8 ; H11#19.2 97.83,90.98 v1(97.83,83.1) ; 73.71,203.74 80.38,203.74 LED2.1 80.47,202.36 80.56,202.27 v1(80.56,197.1) 75.1,197.1 73.64,198.56 73.64,205.74 73.58,205.81 73.58,207.01 73.19,207.39 67.73,207.39 67.35,207.01 67.35,206.4 U1.8 ; H11#11.2 232.83,128.98 v1(232.83,121.1) ; U1#12.8 67.35,130.4 67.35,131.01 67.73,131.39 73.19,131.39 73.58,131.01 73.58,129.81 73.64,129.74 73.64,122.56 75.1,121.1 v1(80.56,121.1) 80.56,126.27 80.47,126.36 LED2#12.1 80.38,127.74 73.71,127.74 ; v1(142.83,83.1) 142.83,90.98 H11#18.2 ; 208.71,13.74 215.38,13.74 LED2#32.1 215.47,12.36 215.56,12.27 v1(215.56,7.1) 210.1,7.1 208.64,8.56 C6#32.2 208.57,15.81 208.57,17.01 208.19,17.39 202.73,17.39 202.35,17.01 202.35,16.4 202.2,16.25 ; H11#20.2 187.83,90.98 v1(187.83,83.1) ; 73.71,51.74 80.38,51.74 LED2#24.1 80.47,50.36 80.56,50.27 v1(80.56,45.1) 75.1,45.1 73.64,46.56 73.64,53.74 73.58,53.81 73.58,55.01 73.19,55.39 67.73,55.39 67.35,55.01 67.35,54.4 U1#24.8 ; v1(277.83,121.1) 277.83,128.98 H11#15.2 ; v1(277.83,159.1) 277.83,166.98 H11#9.2 ; H11#5.2 232.83,166.98 v1(232.83,159.1) ; U1#18.8 67.35,92.4 67.35,93.01 67.73,93.39 73.19,93.39 73.58,93.01 73.58,91.81 73.64,91.74 73.64,84.56 75.1,83.1 v1(80.56,83.1) 80.56,88.27 80.47,88.36 LED2#18.1 80.38,89.74 73.71,89.74 ; 118.71,13.74 125.38,13.74 LED2#31.1 125.47,12.36 125.56,12.27 v1(125.56,7.1) 120.1,7.1 118.64,8.56 118.64,15.74 118.58,15.81 118.58,17.01 118.19,17.39 112.73,17.39 112.35,17.01 112.35,16.4 U1#30.8 ; v1(52.83,121.1) 52.83,128.98 H11#16.2 ; H11#2.2 142.83,204.98 v1(142.83,197.1) ; 118.71,165.74 125.38,165.74 LED2#7.1 125.47,164.36 125.56,164.27 v1(125.56,159.1) 120.1,159.1 118.64,160.56 118.64,167.74 118.58,167.81 118.58,169.01 118.19,169.39 112.73,169.39 112.35,169.01 112.35,168.4 U1#7.8 ; H11#24.2 142.83,52.98 v1(142.83,45.1) ; 247.2,54.25 247.35,54.4 247.35,55.01 247.73,55.39 253.19,55.39 253.57,55.01 253.57,53.81 C6#27.2 253.64,46.56 255.1,45.1 v1(260.56,45.1) 260.56,50.27 260.47,50.36 LED2#27.1 260.38,51.74 253.71,51.74 ; 163.71,51.74 170.38,51.74 LED2#23.1 170.47,50.36 170.56,50.27 v1(170.56,45.1) 165.1,45.1 163.64,46.56 C6#25.2 163.57,53.81 163.57,55.01 163.19,55.39 157.73,55.39 157.35,55.01 157.35,54.4 157.2,54.25 ; v1(97.83,159.1) 97.83,166.98 H11#7.2 ; 253.71,127.74 260.38,127.74 LED2#15.1 260.47,126.36 260.56,126.27 v1(260.56,121.1) 255.1,121.1 253.64,122.56 C6#15.2 253.57,129.81 253.57,131.01 253.19,131.39 247.73,131.39 247.35,131.01 247.35,130.4 247.2,130.25 ; v1(52.83,45.1) 52.83,52.98 H11#28.2 ; v1(232.83,197.1) 232.83,204.98 H11#4.2 ; 118.71,127.74 125.38,127.74 LED2#13.1 125.47,126.36 125.56,126.27 v1(125.56,121.1) 120.1,121.1 118.64,122.56 118.64,129.74 118.58,129.81 118.58,131.01 118.19,131.39 112.73,131.39 112.35,131.01 112.35,130.4 U1#13.8 ; H11#8.2 187.83,166.98 v1(187.83,159.1) ; H11#26.2 187.83,52.98 v1(187.83,45.1) ; v1(187.83,197.1) 187.83,204.98 H11#3.2 ; v1(97.83,197.1) 97.83,204.98 H11.2 ; 202.2,168.25 202.35,168.4 202.35,169.01 202.73,169.39 208.19,169.39 208.57,169.01 208.57,167.81 C6#8.2 208.64,160.56 210.1,159.1 v1(215.56,159.1) 215.56,164.27 215.47,164.36 LED2#8.1 215.38,165.74 208.71,165.74 ; v1(277.83,83.1) 277.83,90.98 H11#21.2 ; 247.2,168.25 247.35,168.4 247.35,169.01 247.73,169.39 253.19,169.39 253.57,169.01 253.57,167.81 C6#9.2 253.64,160.56 255.1,159.1 v1(260.56,159.1) 260.56,164.27 260.47,164.36 LED2#9.1 260.38,165.74 253.71,165.74 ; 202.2,206.25 202.35,206.4 202.35,207.01 202.73,207.39 208.19,207.39 208.57,207.01 208.57,205.81 C6.2 208.64,198.56 210.1,197.1 v1(215.56,197.1) 215.56,202.27 215.47,202.36 LED2#4.1 215.38,203.74 208.71,203.74 ; H11#25.2 97.83,52.98 v1(97.83,45.1) ; H11#10.2 52.83,166.98 v1(52.83,159.1) ; 202.2,130.25 202.35,130.4 202.35,131.01 202.73,131.39 208.19,131.39 208.57,131.01 208.57,129.81 C6#14.2 208.64,122.56 210.1,121.1 v1(215.56,121.1) 215.56,126.27 215.47,126.36 LED2#14.1 215.38,127.74 208.71,127.74 ; H11#30.2 142.83,14.98 v1(142.83,7.1) ; 157.2,16.25 157.35,16.4 157.35,17.01 157.73,17.39 163.19,17.39 163.57,17.01 163.57,15.81 C6#31.2 163.64,8.56 165.1,7.1 v1(170.56,7.1) 170.56,12.27 170.47,12.36 LED2#29.1 170.38,13.74 163.71,13.74 ; 28.71,127.74 35.38,127.74 LED2#16.1 35.47,126.36 35.56,126.27 v1(35.56,121.1) 30.1,121.1 28.64,122.56 C6#16.2 28.58,129.81 28.58,131.01 28.19,131.39 22.73,131.39 22.35,131.01 22.35,130.4 U1#16.8 ; 163.71,89.74 170.38,89.74 LED2#17.1 170.47,88.36 170.56,88.27 v1(170.56,83.1) 165.1,83.1 163.64,84.56 C6#19.2 163.57,91.81 163.57,93.01 163.19,93.39 157.73,93.39 157.35,93.01 157.35,92.4 157.2,92.25 ; 157.2,168.25 157.35,168.4 157.35,169.01 157.73,169.39 163.19,169.39 163.57,169.01 163.57,167.81 C6#7.2 163.64,160.56 165.1,159.1 v1(170.56,159.1) 170.56,164.27 170.47,164.36 LED2#5.1 170.38,165.74 163.71,165.74 ; 73.71,165.74 80.38,165.74 LED2#6.1 80.47,164.36 80.56,164.27 v1(80.56,159.1) 75.1,159.1 73.64,160.56 73.64,167.74 73.58,167.81 73.58,169.01 73.19,169.39 67.73,169.39 67.35,169.01 67.35,168.4 U1#6.8 ; U1#22.8 22.35,92.4 22.35,93.01 22.73,93.39 28.19,93.39 28.58,93.01 28.58,91.81 C6#22.2 28.64,84.56 30.1,83.1 v1(35.56,83.1) 35.56,88.27 35.47,88.36 LED2#22.1 35.38,89.74 28.71,89.74 ; 118.71,89.74 125.38,89.74 LED2#19.1 125.47,88.36 125.56,88.27 v1(125.56,83.1) 120.1,83.1 118.64,84.56 118.64,91.74 118.58,91.81 118.58,93.01 118.19,93.39 112.73,93.39 112.35,93.01 112.35,92.4 U1#19.8 ; H11#22.2 52.83,90.98 v1(52.83,83.1) ; H11#17.2 232.83,90.98 v1(232.83,83.1) ; 163.71,127.74 170.38,127.74 LED2#11.1 170.47,126.36 170.56,126.27 v1(170.56,121.1) 165.1,121.1 163.64,122.56 C6#13.2 163.57,129.81 163.57,131.01 163.19,131.39 157.73,131.39 157.35,131.01 157.35,130.4 157.2,130.25 ; H11#14.2 187.83,128.98 v1(187.83,121.1) ; v1(142.83,159.1) 142.83,166.98 H11#6.2 ; H11#27.2 277.83,52.98 v1(277.83,45.1) ; v1(232.83,45.1) 232.83,52.98 H11#23.2 ; 253.71,89.74 260.38,89.74 LED2#21.1 260.47,88.36 260.56,88.27 v1(260.56,83.1) 255.1,83.1 253.64,84.56 C6#21.2 253.57,91.81 253.57,93.01 253.19,93.39 247.73,93.39 247.35,93.01 247.35,92.4 247.2,92.25 ; 28.71,165.74 35.38,165.74 LED2#10.1 35.47,164.36 35.56,164.27 v1(35.56,159.1) 30.1,159.1 28.64,160.56 C6#10.2 28.58,167.81 28.58,169.01 28.19,169.39 22.73,169.39 22.35,169.01 22.35,168.4 U1#10.8 ; 163.71,203.74 170.38,203.74 LED2#3.1 170.47,202.36 170.56,202.27 v1(170.56,197.1) 165.1,197.1 163.64,198.56 C6#4.2 163.57,205.81 163.57,207.01 163.19,207.39 157.73,207.39 157.35,207.01 157.35,206.4 157.2,206.25 ; 118.71,51.74 125.38,51.74 LED2#25.1 125.47,50.36 125.56,50.27 v1(125.56,45.1) 120.1,45.1 118.64,46.56 118.64,53.74 118.58,53.81 118.58,55.01 118.19,55.39 112.73,55.39 112.35,55.01 112.35,54.4 U1#25.8 ; U1#2.8 112.35,206.4 112.35,207.01 112.73,207.39 118.19,207.39 118.58,207.01 118.58,205.81 118.64,205.74 118.64,198.56 120.1,197.1 v1(125.56,197.1) 125.56,202.27 125.47,202.36 LED2#2.1 125.38,203.74 118.71,203.74 ; H11#29.2 232.83,14.98 v1(232.83,7.1) ; v1(97.83,121.1) 97.83,128.98 H11#13.2